# EasyEDA Pro project PR.eprj, board 新大符2.0（下单PCB） (continued)
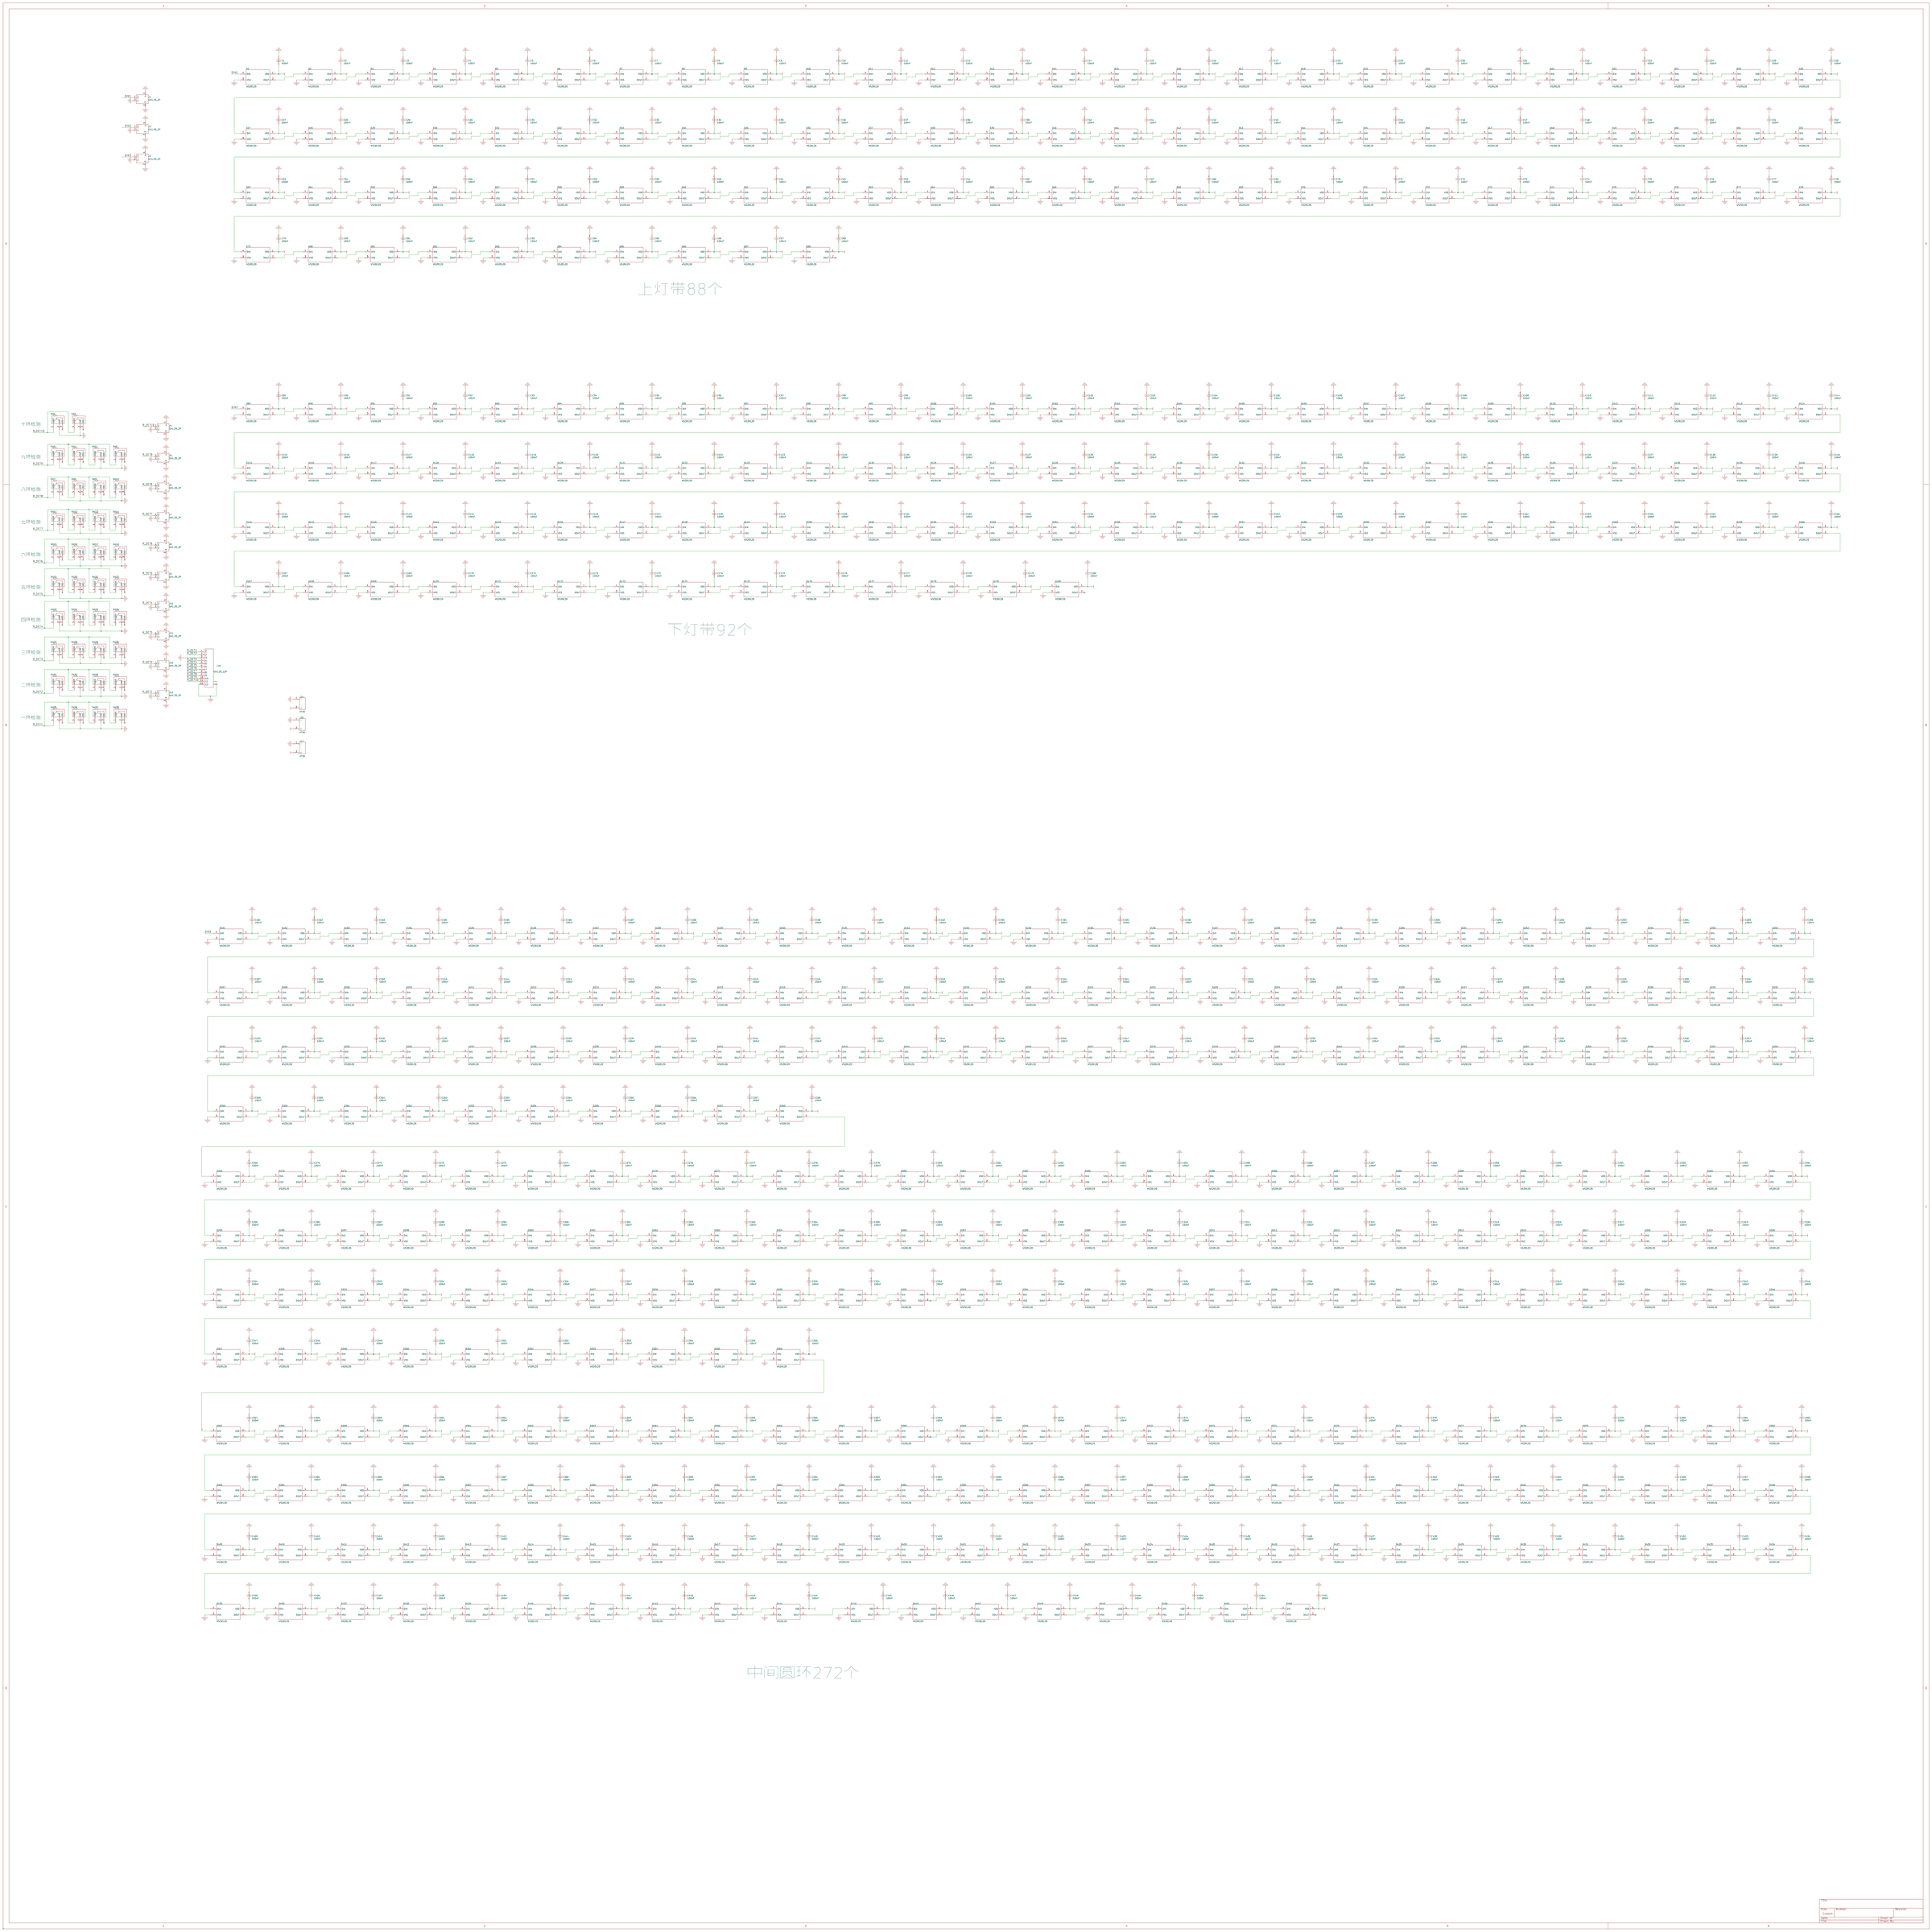
[diagram p0: schematic sheet]
## Routing (per net, layer and track width the routed paths; a pad name or vN(x,y) marks a point on that pad's centre or on a via; arc(x,y) is an arc through that point) (continued)
NETD335_2: length 11.4
  Top Layer w0.381: D336.4 272.68,231.04 278.89,223 D335.2
NETD336_2: length 15.7
  Top Layer w0.381: D337.4 264.57,246.84 274.39,236.21 D336.2
NETD337_2: length 27.2
  Top Layer w0.381: 265.96,252.31 265.33,252.23 254.98,266.21 arc(254.88,266.3) 254.76,266.35 252.95,266.8 arc(252.86,266.81) 252.76,266.8 246.75,265.13 D338.4
NETD338_2: length 14
  Top Layer w0.381: D338.2 246.53,270.57 234.27,273.82 D339.4
NETD339_2: length 15.7
  Top Layer w0.381: D340.4 218.86,281.46 233.09,279.14 D339.2
NETD340_2: length 15.6
  Top Layer w0.381: D341.4 202.4,286.28 216.75,286.48 D340.2
NETD341_2: length 14.6
  Top Layer w0.381: D342.4 186.36,288.18 199.42,290.84 199.85,291.32
NETD342_2: length 9.7
  Top Layer w0.381: D342.2 182.44,291.96 175,287.97 D343.4
NETD343_2: length 13.5
  Top Layer w0.381: D344.4 158.26,292.4 170.46,292.3 D343.2
NETD344_2: length 15.8
  Top Layer w0.381: D345.4 141.99,278.48 153.3,287.65 D344.2
NETD345_2: length 15.4
  Top Layer w0.381: 136.75,280.59 136.75,279.95 127.28,269.47 D346.4
NETD346_2: length 19.9
  Top Layer w0.381: D346.2 122.24,267.76 122.24,267.73 122.24,267.64 119.39,258.59 119.31,258.51 115.29,255.08 115.11,255.08 115.07,255.09 D347.4
NETD347_2: length 13.1
  Top Layer w0.381: 107.44,256.21 107.65,255.61 103.82,244.39 D348.4
NETD348_2: length 15.4
  Top Layer w0.381: D349.4 95.81,229.12 98.56,242.97 D348.2
NETD349_2: length 15.4
  Top Layer w0.381: 91.16,212.26 90.66,212.66 90.89,226.78 90.48,227.26
NETD350_2: length 23.8
  Top Layer w0.381: D350.2 86.24,209.48 102.98,194.36 D351.4
NETD351_2: length 17.6
  Top Layer w0.381: D351.2 98.08,190.45 98,174.14 D352.4
NETD352_2: length 12.5
  Top Layer w0.381: D352.2 102.75,169.18 106.92,161.6 arc(107.05,161.46) 107.23,161.41 109.41,161.29 D353.4
NETD353_2: length 15.3
  Top Layer w0.381: D353.2 107.55,156.17 117.61,146.34 D354.4
NETD354_2: length 19.7
  Top Layer w0.381: D355.4 131.86,132.7 132.1,132.95 132.1,133.58 127.96,137.72 127.88,137.75 118.55,141.14 118.46,141.14 118.44,141.14 D354.2
NETD355_2: length 12.5
  Top Layer w0.381: D355.2 131.64,126.57 142.3,123.08 142.84,123.41
NETD357_2: length 11.6
  Top Layer w0.381: 169.3,113.61 168.94,113.08 158.63,112.53 158.17,112.1
NETD358_2: length 11.5
  Top Layer w0.381: D359.4 182.44,110.86 172.44,108.91 172.07,108.39
NETD359_2: length 21
  Top Layer w0.381: D359.2 186.36,107.08 206.1,108.04 D360.4
NETD360_2: length 16.6
  Top Layer w0.381: D361.4 223.85,121.25 211.06,112.78 210.6,112.34
NETD361_2: length 11.7
  Top Layer w0.381: D361.2 229.13,119.93 235.22,128.41 D362.4
NETD362_2: length 21.7
  Top Layer w0.381: D363.4 250.69,140.94 250.73,140.86 250.73,140.71 247.4,131.07 247.33,131.01 243.41,127.47 243.25,127.47 243.24,127.47 D362.2
NETD363_2: length 15.3
  Top Layer w0.381: D364.4 258.41,157.94 254.92,144.32 D363.2
NETD364_2: length 15.3
  Top Layer w0.381: D365.4 264.04,174.04 263.46,159.99 263.84,159.48
NETD365_2: length 14.8
  Top Layer w0.381: D366.4 266.21,190.45 268.56,177.09 269.04,176.67
NETD366_2: length 14.4
  Top Layer w0.381: 271.6,208.12 271.44,207.5 271.11,194.36 270.55,194.06
NETD367_2: length 13.8
  Top Layer w0.381: D368.4 259.9,223.03 266.7,212.46 D367.2
NETD368_2: length 16.2
  Top Layer w0.381: D368.2 261.76,228.14 251.71,239.24 D369.4
NETD369_2: length 24.6
  Top Layer w0.381: 245.49,255.05 240.84,256.4 arc(240.79,256.41) 240.74,256.41 236.83,256.41 arc(235.84,256) D370.4 ; 252.46,244.63 D369.2 252.92,244.96 245.69,254.91 arc(245.61,255) 245.49,255.05
NETD370_2: length 16.3
  Top Layer w0.381: 222.49,263.19 D371.4 233.2,262.86 arc(234.17,262.67) 234.99,262.12 D370.2 235.65,260.65
NETD371_2: length 18.3
  Top Layer w0.381: D371.2 220.99,268.43 204.23,271.15 D372.4
NETD372_2: length 16.8
  Top Layer w0.381: D372.2 201.67,275.96 186.36,273.66 D373.4
NETD373_2: length 7.9
  Top Layer w0.381: 182.75,278 182.45,277.44 177.03,273.66 D374.4
NETD374_2: length 11.4
  Top Layer w0.381: D375.4 162.33,276.52 172.67,277.61 D374.2
NETD375_2: length 15.7
  Top Layer w0.381: 145.42,263.14 145.4,263.78 157.37,271.78 157.83,272.22
NETD376_2: length 13
  Top Layer w0.381: D377.4 132.9,255.81 140.12,265.1 D376.2
NETD377_2: length 18.6
  Top Layer w0.381: D377.2 126.79,256.65 126.78,256.65 126.63,256.65 121.72,252.23 121.71,252.23 121.64,252.16 118.96,244.07 118.96,243.92 118.99,243.85 D378.4
NETD378_2: length 15.3
  Top Layer w0.381: D379.4 110.91,227.63 114.4,241.25 D378.2
NETD379_2: length 15.3
  Top Layer w0.381: D380.4 105.27,211.53 105.86,225.59 105.47,226.1
NETD380_2: length 24.1
  Top Layer w0.381: 100.28,208.91 100.76,208.49 118.68,194.36 D381.4
NETD381_2: length 18.5
  Top Layer w0.381: D382.4 113.88,173.12 113.88,190.44 D381.2
NETD382_2: length 10.5
  Top Layer w0.381: 126.44,162.43 125.8,162.43 118.62,168.16 118.18,168.62
NETD383_2: length 10.8
  Top Layer w0.381: D384.4 132.49,152.17 124.38,157.17 D383.2
NETD384_2: length 21.5
  Top Layer w0.381: D385.4 146.36,137.31 146.27,137.26 146.12,137.26 134.02,140.79 133.93,140.88 131.26,144.71 131.26,144.89 131.28,144.94 D384.2
NETD385_2: length 14.8
  Top Layer w0.381: D386.4 162.11,130.39 148.72,132.61 D385.2
NETD386_2: length 14.9
  Top Layer w0.381: D386.2 164.67,125.58 178.2,126.79 D387.4
NETD387_2: length 13.7
  Top Layer w0.381: D388.4 193.49,127.22 181.87,122.77 D387.2
NETD388_2: length 13.9
  Top Layer w0.381: D389.4 210.8,124.8 198.26,123.14 D388.2
NETD389_2: length 15.3
  Top Layer w0.381: D390.4 224.71,140.28 215.76,129.54 215.3,129.1
NETD390_2: length 18.5
  Top Layer w0.381: 236.6,152.65 237.87,149.93 237.91,149.86 237.91,149.74 236.6,142.26 236.51,142.16 232.28,138.67 232.09,138.67 232.03,138.68 D390.2
NETD391_2: length 14.6
  Top Layer w0.381: D391.2 242.23,153.02 244.77,166.12 D392.4
NETD392_2: length 14.9
  Top Layer w0.381: D393.4 249.37,181.95 249.73,168.37 D392.2
NETD393_2: length 15.1
  Top Layer w0.381: D394.4 249.13,198.39 253.62,185.36 D393.2
NETD394_2: length 10.6
  Top Layer w0.381: D395.4 254.3,212.2 253.5,202.89 252.99,202.52
NETD395_2: length 17.4
  Top Layer w0.381: D395.2 249.55,217.16 238.83,229.21 D396.4
NETD396_2: length 22.8
  Top Layer w0.381: 224.67,244.4 225.27,244.63 231.55,245.98 arc(231.65,245.99) 231.75,245.97 236.18,244.53 ; D396.2 240.49,235.26 236.41,244.32 arc(236.31,244.45) 236.18,244.53
NETD397_2: length 11.7
  Top Layer w0.381: 213.78,250.48 214.3,250.86 224.66,250.04 D397.2
NETD398_2: length 14.9
  Top Layer w0.381: D399.4 198.78,257.29 212.37,255.95 D398.2
NETD399_2: length 11.1
  Top Layer w0.381: D399.2 195.64,261.73 186.61,257.82 D400.4
NETD400_2: length 18.2
  Top Layer w0.381: D401.4 165.5,261.66 182.39,262.47 D400.2
NETD401_2: length 13.8
  Top Layer w0.381: D401.2 160.54,256.92 150.96,248.89 151,248.25
NETD402_2: length 20.2
  Top Layer w0.381: D402.2 145.78,247.44 145.78,247.43 145.78,247.33 140.97,237.62 138.48,234.97 138.48,234.97 138.37,234.85 138.21,234.85 D403.4
NETD403_2: length 11.1
  Top Layer w0.381: D403.2 130.5,235.2 127.82,225.77 D404.4
NETD404_2: length 14.9
  Top Layer w0.381: D405.4 121.26,210.64 122.62,224.16 D404.2
NETD405_2: length 22.7
  Top Layer w0.381: 133.72,193.8 133.16,194.11 116.63,207.79 D405.2
NETD406_2: length 14.6
  Top Layer w0.381: 128.71,175.93 128.86,176.55 128.86,190.19 D406.2
NETD407_2: length 12.9
  Top Layer w0.381: D408.4 141.99,163.51 133.61,171.59 D407.2
NETD408_2: length 17.7
  Top Layer w0.381: D408.2 141.02,158.42 141.07,158.45 143.47,158.75 147.05,158.96 ; 147.05,158.96 149.32,159.09 149.49,159.09 149.61,158.96 149.62,158.95 153.8,153.83 153.8,153.67 153.79,153.65 D409.4
NETD409_2: length 14.7
  Top Layer w0.381: D409.2 153.96,146.38 167.13,143.95 D410.4
NETD410_2: length 14.7
  Top Layer w0.381: D411.4 182.96,140.9 169.69,139.14 D410.2
NETD411_2: length 14.3
  Top Layer w0.381: D412.4 200,136.99 186.88,136.99 D411.2
NETD412_2: length 13
  Top Layer w0.381: 213.48,150.38 213.55,149.74 204.96,141.74 204.5,141.29
NETD413_2: length 17.4
  Top Layer w0.381: D414.4 226.51,158.21 226.55,158.14 226.55,158.04 226.19,153.07 226.07,152.95 219.84,148.26 219.68,148.26 219.66,148.26 D413.2
NETD414_2: length 14.7
  Top Layer w0.381: D414.2 230.69,161.71 233.11,174.87 232.68,175.34
NETD415_2: length 14.7
  Top Layer w0.381: D416.4 236.16,190.71 237.92,177.43 D415.2
NETD416_2: length 14
  Top Layer w0.381: D417.4 239.82,207.37 239.94,194.62 240.5,194.31
NETD417_2: length 13.1
  Top Layer w0.381: D417.2 235.07,212.33 227.32,221.3 226.69,221.22
NETD418_2: length 19.1
  Top Layer w0.381: D419.4 220.56,235.11 220.64,235.14 220.74,235.14 225.53,234.7 225.64,234.59 229.09,230.28 229.09,230.12 229.08,230.1 228.71,226.77
NETD419_2: length 15.1
  Top Layer w0.381: 216.36,238.95 216.23,238.91 215.79,238.68 202.19,240.86 D420.4
NETD420_2: length 14.7
  Top Layer w0.381: D421.4 186.36,243.91 199.63,245.67 D420.2
NETD421_2: length 14.3
  Top Layer w0.381: 168.82,247.47 169.44,247.31 182.44,247.69 182.75,248.25
NETD422_2: length 12.8
  Top Layer w0.381: D423.4 155.76,235.07 164.48,242.57 164.94,243.01
NETD423_2: length 18.4
  Top Layer w0.381: 144.65,223.39 146.96,223.11 146.99,223.1 147.14,223.1 151.74,226.87 151.75,226.88 151.87,227 151.87,227.18 150.78,236.06 150.67,236.16 150.65,236.18 D423.2
NETD424_2: length 14.7
  Top Layer w0.381: 136.64,209.47 136.2,209.94 139.02,223.02 138.75,223.6
NETD425_2: length 22.4
  Top Layer w0.381: 130.96,207.85 131.4,207.38 148.4,194.87 D426.4
NETD426_2: length 12.4
  Top Layer w0.381: 144.06,191.26 143.88,191.09 143.88,179.04 143.95,178.98
NETD427_2: length 19.1
  Top Layer w0.381: D427.2 148.59,175.15 148.9,175.15 160.78,168.02 160.81,167.99 162.06,166.77 ; 162.97,164.22 162.18,165.01 162.18,166.65 162.07,166.77
NETD428_2: length 11.2
  Top Layer w0.381: 173.05,159.05 173.01,159.05 172.5,158.53 162.31,158.53 162.15,158.37
NETD429_2: length 12
  Top Layer w0.381: 185.84,156.76 185.59,156.17 175.14,153.81 D429.2
NETD430_2: length 7.9
  Top Layer w0.381: D431.4 196.58,151.22 190,151.71 D430.2
NETD431_2: length 22.5
  Top Layer w0.381: 201.08,155.52 201.54,155.96 205.45,162.24 arc(205.48,162.31) 205.5,162.38 206.07,165.9 206.29,167.27 206.31,167.39 210.3,171.51 210.4,171.61 210.53,171.62 211.74,171.76 213.11,171.91 213.74,171.83
NETD432_2: length 11.2
  Top Layer w0.381: D433.4 220.95,181.95 219.37,172.2 D432.2
NETD433_2: length 9.3
  Top Layer w0.381: D433.2 225.47,185 220.8,191.55 D434.4
NETD434_2: length 9.8
  Top Layer w0.381: D435.4 224.96,205.09 224.52,196.6 224.06,196.16
NETD435_2: length 25.7
  Top Layer w0.381: 220.66,209.58 220.21,210.05 216.09,221.57 arc(216,221.71) 215.86,221.8 209.68,223.86 arc(209.55,223.88) 209.43,223.86 ; 204.13,221.83 204.68,222.16 209.43,223.86
NETD436_2: length 13.5
  Top Layer w0.381: D437.4 190.71,227.6 203.6,227.6 D436.2
NETD437_2: length 15.2
  Top Layer w0.381: D438.4 172.56,232.54 187.6,232.54 D437.2
NETD438_2: length 23.1
  Top Layer w0.381: 162.72,214.81 156.25,212.82 D439.4 ; 168.62,228.02 168.16,227.58 165.01,225.9 arc(164.88,225.79) 164.82,225.63 162.98,215.11 arc(162.89,214.93) 162.72,214.82
NETD439_2: length 10
  Top Layer w0.381: D439.2 150.08,214.29 150.08,205.93 150.99,205.02 D440.4
NETD440_2: length 19.5
  Top Layer w0.381: D441.4 156.97,189.09 145.56,203.32 D440.2
NETD441_2: length 17.8
  Top Layer w0.381: D442.4 175.08,174.87 175.08,175.31 169.42,180.98 165.64,180.98 162.38,184.23 162.35,184.23 161.87,184.72 161.87,184.75
NETD442_2: length 15.7
  Top Layer w0.381: 188.43,163.63 187.81,163.79 174.42,169.11 D442.2
NETD443_2: length 18.5
  Top Layer w0.381: 192.31,168.09 192.77,168.53 195.54,171.2 195.54,171.2 195.63,171.3 196.59,178.76 196.7,178.86 196.71,178.87 200.98,182.41 D444.4
NETD444_2: length 17.3
  Top Layer w0.381: D444.2 207.21,181.72 212.89,196.7 D445.4
NETD445_2: length 23.9
  Top Layer w0.381: 200.06,214.09 194.25,212.1 193.64,211.93 ; 207.57,208.37 202.9,213.52 arc(202.81,213.6) 202.69,213.64 200.25,214.1 arc(200.15,214.11) 200.06,214.09 ; D445.2 208.75,201.82 207.66,208.18 arc(207.63,208.28) 207.57,208.37
NETD446_2: length 15.2
  Top Layer w0.381: D446.2 194.16,217.55 180.61,220.89 179.99,221.05
NETD447_2: length 23
  Top Layer w0.381: D447.2 175.57,216.74 175.52,216.76 175.42,216.76 172.67,216.02 172.63,216 164.48,211.34 164.41,211.28 160.83,205.44 160.83,205.28 160.84,205.22 D448.4
NETD448_2: length 12.7
  Top Layer w0.381: D448.2 167.6,201.21 170.14,201.21 176.13,195.21 176.13,193.8
NETD449_2: length 18.3
  Top Layer w0.381: 183.99,177.67 183.88,177.98 183.88,178.04 183.64,178.88 171.79,190.19 D449.2
NETD450_2: length 11.4
  Top Layer w0.381: D451.4 192.14,190.43 191.25,190.21 arc(191.07,190.1) 190.97,189.9 ; 188.89,180.97 189.45,181.28 190.97,189.9
NETD451_2: length 20.2
  Top Layer w0.381: 184.73,206.63 188.6,206.63 197.6,197.62 197.6,194.04
R_DET1: length 675.5
  Top Layer w0.381: 47.2,159.59 49.12,159.59 arc(50.09,159.4) 50.92,158.85 52.53,157.23 arc(112.06,76.99) 210.32,58.89 212.85,58.89 arc(213.82,58.7) 214.65,58.15 216.45,56.34 216.45,56.97 arc(216.65,57.94) 217.2,58.76 219.44,61.01 arc(299.78,120.5) 317.92,218.8 317.92,220.22 arc(318.11,221.19) 318.66,222.02 321.1,224.46 320.18,224.46 arc(319.21,224.65) 318.38,225.2 315.87,227.72 arc(255.3,308.91) 155.45,325.9 arc(154.84,326.02) 154.33,326.37 151.72,328.98
  Bottom Layer w0.381: 151.72,328.98 152.31,328.39 arc(152.84,327.58) J13.1 ; 321.1,224.46 321.19,224.12 338.41,221.23 J18.1
R_DET2: length 622.5
  Top Layer w0.381: 155.15,314.5 157.82,311.82 ; 61.68,163.4 61.94,163.4 arc(62.17,163.45) 62.36,163.58 63.31,163.58 arc(64.28,163.38) 65.11,162.83 66.05,161.89 arc(119.81,88.8) 209.16,72.96 209.58,72.96 arc(210.55,72.77) 211.38,72.21 213.02,70.57 213.02,71.01 arc(213.22,71.98) 213.77,72.81 215.39,74.43 arc(288.11,128.22) 303.88,217.29 arc(303.96,217.73) 304.22,218.11 307.38,221.28 305.8,221.28 arc(304.83,221.47) 304,222.02 302.38,223.65 arc(247.89,296.79) 157.91,311.79
  Bottom Layer w0.381: 155.15,314.5 155.76,313.88 arc(156.29,313.09) J12.1 ; 307.38,221.28 307.48,220.94 338.41,219.98 J18.2
R_DET3: length 564.6
  Top Layer w0.381: SW28.1 78.2,166.45 arc(79.17,166.26) 79.99,165.71 81.42,164.28 arc(128.63,100.56) 206.75,86.91 arc(207.54,86.75) 208.22,86.3 209.39,85.13 arc(209.57,86.06) 210.1,86.85 211.19,87.94 arc(275.65,135.22) 289.29,213.99 289.29,214.32 arc(289.48,215.29) 290.03,216.12 291.64,217.72 291.21,217.72 arc(290.23,217.92) 289.41,218.47 286.88,221 arc(269.66,256.02) 240.87,282.37 arc(203.97,296.62) 164.41,296.45 arc(164.37,296.45) 164.33,296.45 arc(163.35,296.65) 162.53,297.21 SW27.1
  Bottom Layer w0.381: J18.4 338.41,217.39 291.73,217.39 291.64,217.72 ; SW27.1 159.42,300.74 159.69,300.05 160.12,298.92 J11.1
R_DET4: length 508.8
  Top Layer w0.381: 162.39,285.92 165.25,283.06 arc(165.8,282.69) 166.45,282.56 arc(233.11,270.41) 273.4,215.92 274.92,214.4 arc(275.74,213.85) 276.71,213.66 277.03,213.66 275.53,212.16 arc(274.98,211.33) 274.78,210.36 274.78,209.9 arc(262.17,142.96) 207.01,103.01 206.19,102.2 arc(205.64,101.37) 205.45,100.4 SW25.1 204.38,101.06 arc(203.55,101.61) 202.58,101.8 201.56,101.8 arc(135.68,114.15) 95.63,167.89 94.39,169.14 arc(93.56,169.69) 92.59,169.88 90.76,169.88
  Bottom Layer w0.381: 162.39,285.92 162.97,285.34 arc(163.51,284.53) J10.1 ; J18.5 338.41,216.01 277.12,213.32 277.03,213.66
R_DET5: length 453.7
  Top Layer w0.381: SW19.1 167.57,268.8 arc(168.39,268.25) 169.37,268.06 170.06,268.06 arc(225.73,257.41) 259.1,211.59 259.84,210.85 arc(260.66,210.3) 261.63,210.1 262.94,210.1 260.64,207.81 arc(260.3,207.31) 260.19,206.73 arc(249.48,150.83) 203.36,117.49 202.64,116.77 arc(202.09,115.95) 201.89,114.97 SW21.1 200.67,115.56 arc(199.84,116.11) 198.87,116.31 197.87,116.31 arc(142.37,127.6) 109.53,173.75 106.51,173.75 arc(106.09,173.67) 105.75,173.44
  Bottom Layer w0.381: 262.94,210.1 263.03,209.77 338.41,214.76 J18.6 ; SW19.1 166.78,269.59 arc(167.32,268.78) J9.1
R_DET6: length 398.6
  Top Layer w0.381: 169.88,255.44 170.22,255.53 171.22,253.45 ; 120.22,177.37 120.31,177.04 123.34,177.65 arc(123.44,177.66) 123.53,177.64 124.01,177.5 124.21,177.13 arc(150.99,139.96) 195.97,131.27 196.48,131.27 arc(197.45,131.08) 198.28,130.53 199.48,129.32 199.48,130.04 arc(199.68,131.01) 200.23,131.83 200.77,132.38 arc(237.03,159.32) 245.43,203.7 arc(245.59,204.48) 246.03,205.14 248.08,207.18 246.64,207.18 arc(245.67,207.38) 244.84,207.93 244.36,208.41 arc(217.33,244.9) 172.7,253.23 171.56,253.24 arc(171.36,253.29) 171.22,253.45
  Bottom Layer w0.381: 248.08,207.18 248.17,206.84 338.41,213.51 J18.7 ; 169.88,255.44 170.47,254.86 arc(171.01,254.05) J8.1
R_DET7: length 339.3
  Top Layer w0.381: 195.88,143.34 193.84,145.38 arc(193.01,145.93) 192.04,146.13 191.67,146.13 arc(159.84,152.55) 139.89,178.16 139.28,179.63 arc(139.16,179.79) 138.98,179.86 135.43,180.34 135.34,180.68 ; 175.68,238.64 179.83,238.75 arc(210.55,230.98) 229.24,205.4 231.15,203.48 arc(231.98,202.93) 232.95,202.74 233.47,202.74 231.55,200.81 arc(231,199.99) 230.8,199.02 230.8,197.73 arc(223.68,166.97) 198.61,147.77 196.62,145.78 arc(196.1,145.03) 195.88,144.14 ; 173.18,240.96 173.52,241.05 175.37,238.78 arc(175.51,238.67) 175.68,238.64
  Bottom Layer w0.381: 173.18,240.96 175.8,240.96 arc(175.86,240.95) J7.1 ; 233.47,202.74 233.56,202.4 298.62,208.99 arc(298.63,208.99) 298.64,208.99 338.41,212.26 J18.8
R_DET8: length 287.1
  Top Layer w0.381: 177.25,225.98 178.58,224.65 arc(179.4,224.09) 180.38,223.9 183.77,223.9 arc(201.97,220.09) 213.78,205.72 arc(213.95,204.85) 214.44,204.12 218.36,200.2 216.64,198.48 arc(216.09,197.66) 215.9,196.69 215.9,194.56 arc(211.85,176.53) 197.81,164.49 193.07,159.75 arc(192.52,158.92) 192.32,157.95 192.32,157.94 191.2,159.07 arc(190.37,159.62) 189.4,159.81 186.69,159.81 arc(173.77,162.38) 162.81,169.7 arc(158.26,175.17) 154.78,181.39 152.99,183.17 arc(151.77,183.98) .1
  Bottom Layer w0.381: 177.25,225.98 177.34,226.08 arc(178.17,226.63) 179.14,226.82 J6.1 ; 329.62,205.34 232.39,193.94 arc(232.29,193.94) 232.19,193.97 ; J18.9 338.41,211.01 332.7,210.58 arc(332.52,210.52) 332.39,210.38 329.91,205.54 arc(329.79,205.4) 329.62,205.34 ; 218.36,200.2 218.45,199.86 232.19,193.97
R_DET9: length 236.6
  Top Layer w0.381: 163.91,193.25 164,192.91 183.38,169.89 SW5.1 184.05,170.07 192.52,177.22 arc(192.54,177.22) 192.55,177.24 206.79,191.22 SW6.1 206.61,191.9 185.46,214.64 SW3.1
  Bottom Layer w0.381: J18.10 338.41,209.76 334.75,209.69 arc(334.55,209.63) 334.42,209.48 331.18,203.12 arc(331.06,202.98) 330.9,202.92 225.7,186.29 206.79,191.22 SW6.1 ; SW3.1 185.56,214.1 arc(185.93,213.8) 186.35,213.57 arc(186.84,213.41) 187.36,213.36 J5.1
R_DET10: length 187.5
  Top Layer w0.381: SW1.1 185.96,199.26 178.92,195.94 arc(178.76,195.79) 178.71,195.58 179.19,188.12 ; 183.01,184.79 182.66,184.79 182.59,184.85 179.31,187.87 arc(179.22,187.98) 179.19,188.12
  Bottom Layer w0.381: J4.1 188.75,197.88 arc(187.78,198.07) 186.95,198.62 SW1.1 ; 183.01,184.79 184.23,184.79 190.53,182.39 190.57,182.38 219.32,178.55 219.34,178.55 219.4,178.55 333.16,201.93 333.29,202.06 333.32,202.13 335.96,207.96 arc(336.07,208.11) 336.25,208.18 338.41,208.51 J18.11

## Copper pours and planes (outline as drawn; the poured copper is in the pictures)
GND on Top Layer: 14.99,253.11 27.94,351.92 134.37,381.51 234.82,381.63 340.61,349.38 355.35,247.78 345.44,237.74 346.33,155.32 346.33,154.94 363.35,149.48 369.95,29.72 221.36,0.13 147.7,0.13 0.13,33.15 7.24,146.94 20.83,150.75 21.34,240.54
GND on Bottom Layer: 182.5,224.66 181.61,227.84 178.94,227.2 178.69,228.22 180.21,228.6 180.98,230.25 180.85,231.01 183.95,231.82 185.6,225.47
GND on Bottom Layer: 190.63,211.2 189.74,214.38 187.07,213.74 186.82,214.76 188.34,215.14 189.1,216.79 188.98,217.55 192.08,218.36 193.73,212.01
GND on Bottom Layer: 338.2,207.77 341.5,207.77 341.5,207.01 338.2,207.01
GND on Bottom Layer: 165.35,265.56 168.53,266.45 167.89,269.11 168.91,269.37 169.29,267.84 170.94,267.08 171.7,267.21 172.51,264.11 166.16,262.46
GND on Bottom Layer: 341,223.52 343.79,223.52 343.79,205.11 341,205.11
GND on Bottom Layer: 150.88,324.36 154.05,325.25 153.42,327.91 154.43,328.17 154.81,326.64 156.46,325.88 157.23,326.01 158.03,322.91 151.68,321.26
GND on Bottom Layer: 338.2,218.95 341.12,218.95 341.12,218.31 338.2,218.31
GND on Bottom Layer: 178.18,238.76 177.29,241.94 174.62,241.3 174.37,242.32 175.89,242.7 176.66,244.35 176.53,245.11 179.63,245.92 181.28,239.57
GND on Bottom Layer: 169.04,250.83 172.21,251.71 171.58,254.38 172.59,254.64 172.97,253.11 174.62,252.35 175.39,252.48 176.2,249.38 169.85,247.73
GND on Bottom Layer: 161.54,281.31 164.72,282.19 164.08,284.86 165.1,285.12 165.48,283.59 167.13,282.83 167.89,282.96 168.7,279.86 162.35,278.21
GND on Bottom Layer: 154.32,309.87 157.5,310.76 156.86,313.43 157.88,313.68 158.26,312.16 159.91,311.39 160.67,311.52 161.48,308.42 155.13,306.77
GND on Bottom Layer: 158.24,296.04 161.42,296.93 160.78,299.59 161.8,299.85 162.18,298.32 163.83,297.56 164.59,297.69 165.4,294.59 159.05,292.94
GND on Bottom Layer: 31.33,157.02 31.33,153.63 27.78,153.61 27.78,151.07 26.78,151.07 26.78,152.5 25.54,153.62 24.48,153.62 24.48,157.02
GND on Bottom Layer: 193.93,195.07 190.54,195.07 190.51,198.62 187.97,198.62 187.97,199.63 189.41,199.63 190.52,200.87 190.52,201.93 193.93,201.93
GND on Bottom Layer: 24.48,231.9 24.48,235.3 28.03,235.32 28.03,237.86 29.03,237.86 29.03,236.42 30.27,235.31 31.33,235.31 31.33,231.9
GND on Bottom Layer: 27.94,195.96 31.33,195.96 31.36,192.41 33.9,192.41 33.9,191.4 32.46,191.4 31.35,190.16 31.35,189.1 27.94,189.1
VCC on Bottom Layer: 0,33.02 6.98,147.07 20.7,150.88 21.21,240.67 14.86,252.98 27.81,351.92 134.37,381.51 234.82,381.76 340.74,349.38 355.47,247.4 345.57,237.36 346.46,155.07 363.6,149.48 370.08,29.59 221.34,0 147.68,0

## Text on the board
Bottom Silkscreen Layer: 1 | G | 10 | DIN3 | DIN1 | DIN2
